# EasyEDA Pro project ProProject_Avaota Pi A_2024-03-25.epro, schematic Avaota Pi A, sheets 1 to 5 of 13

## Sheets
1 POWER
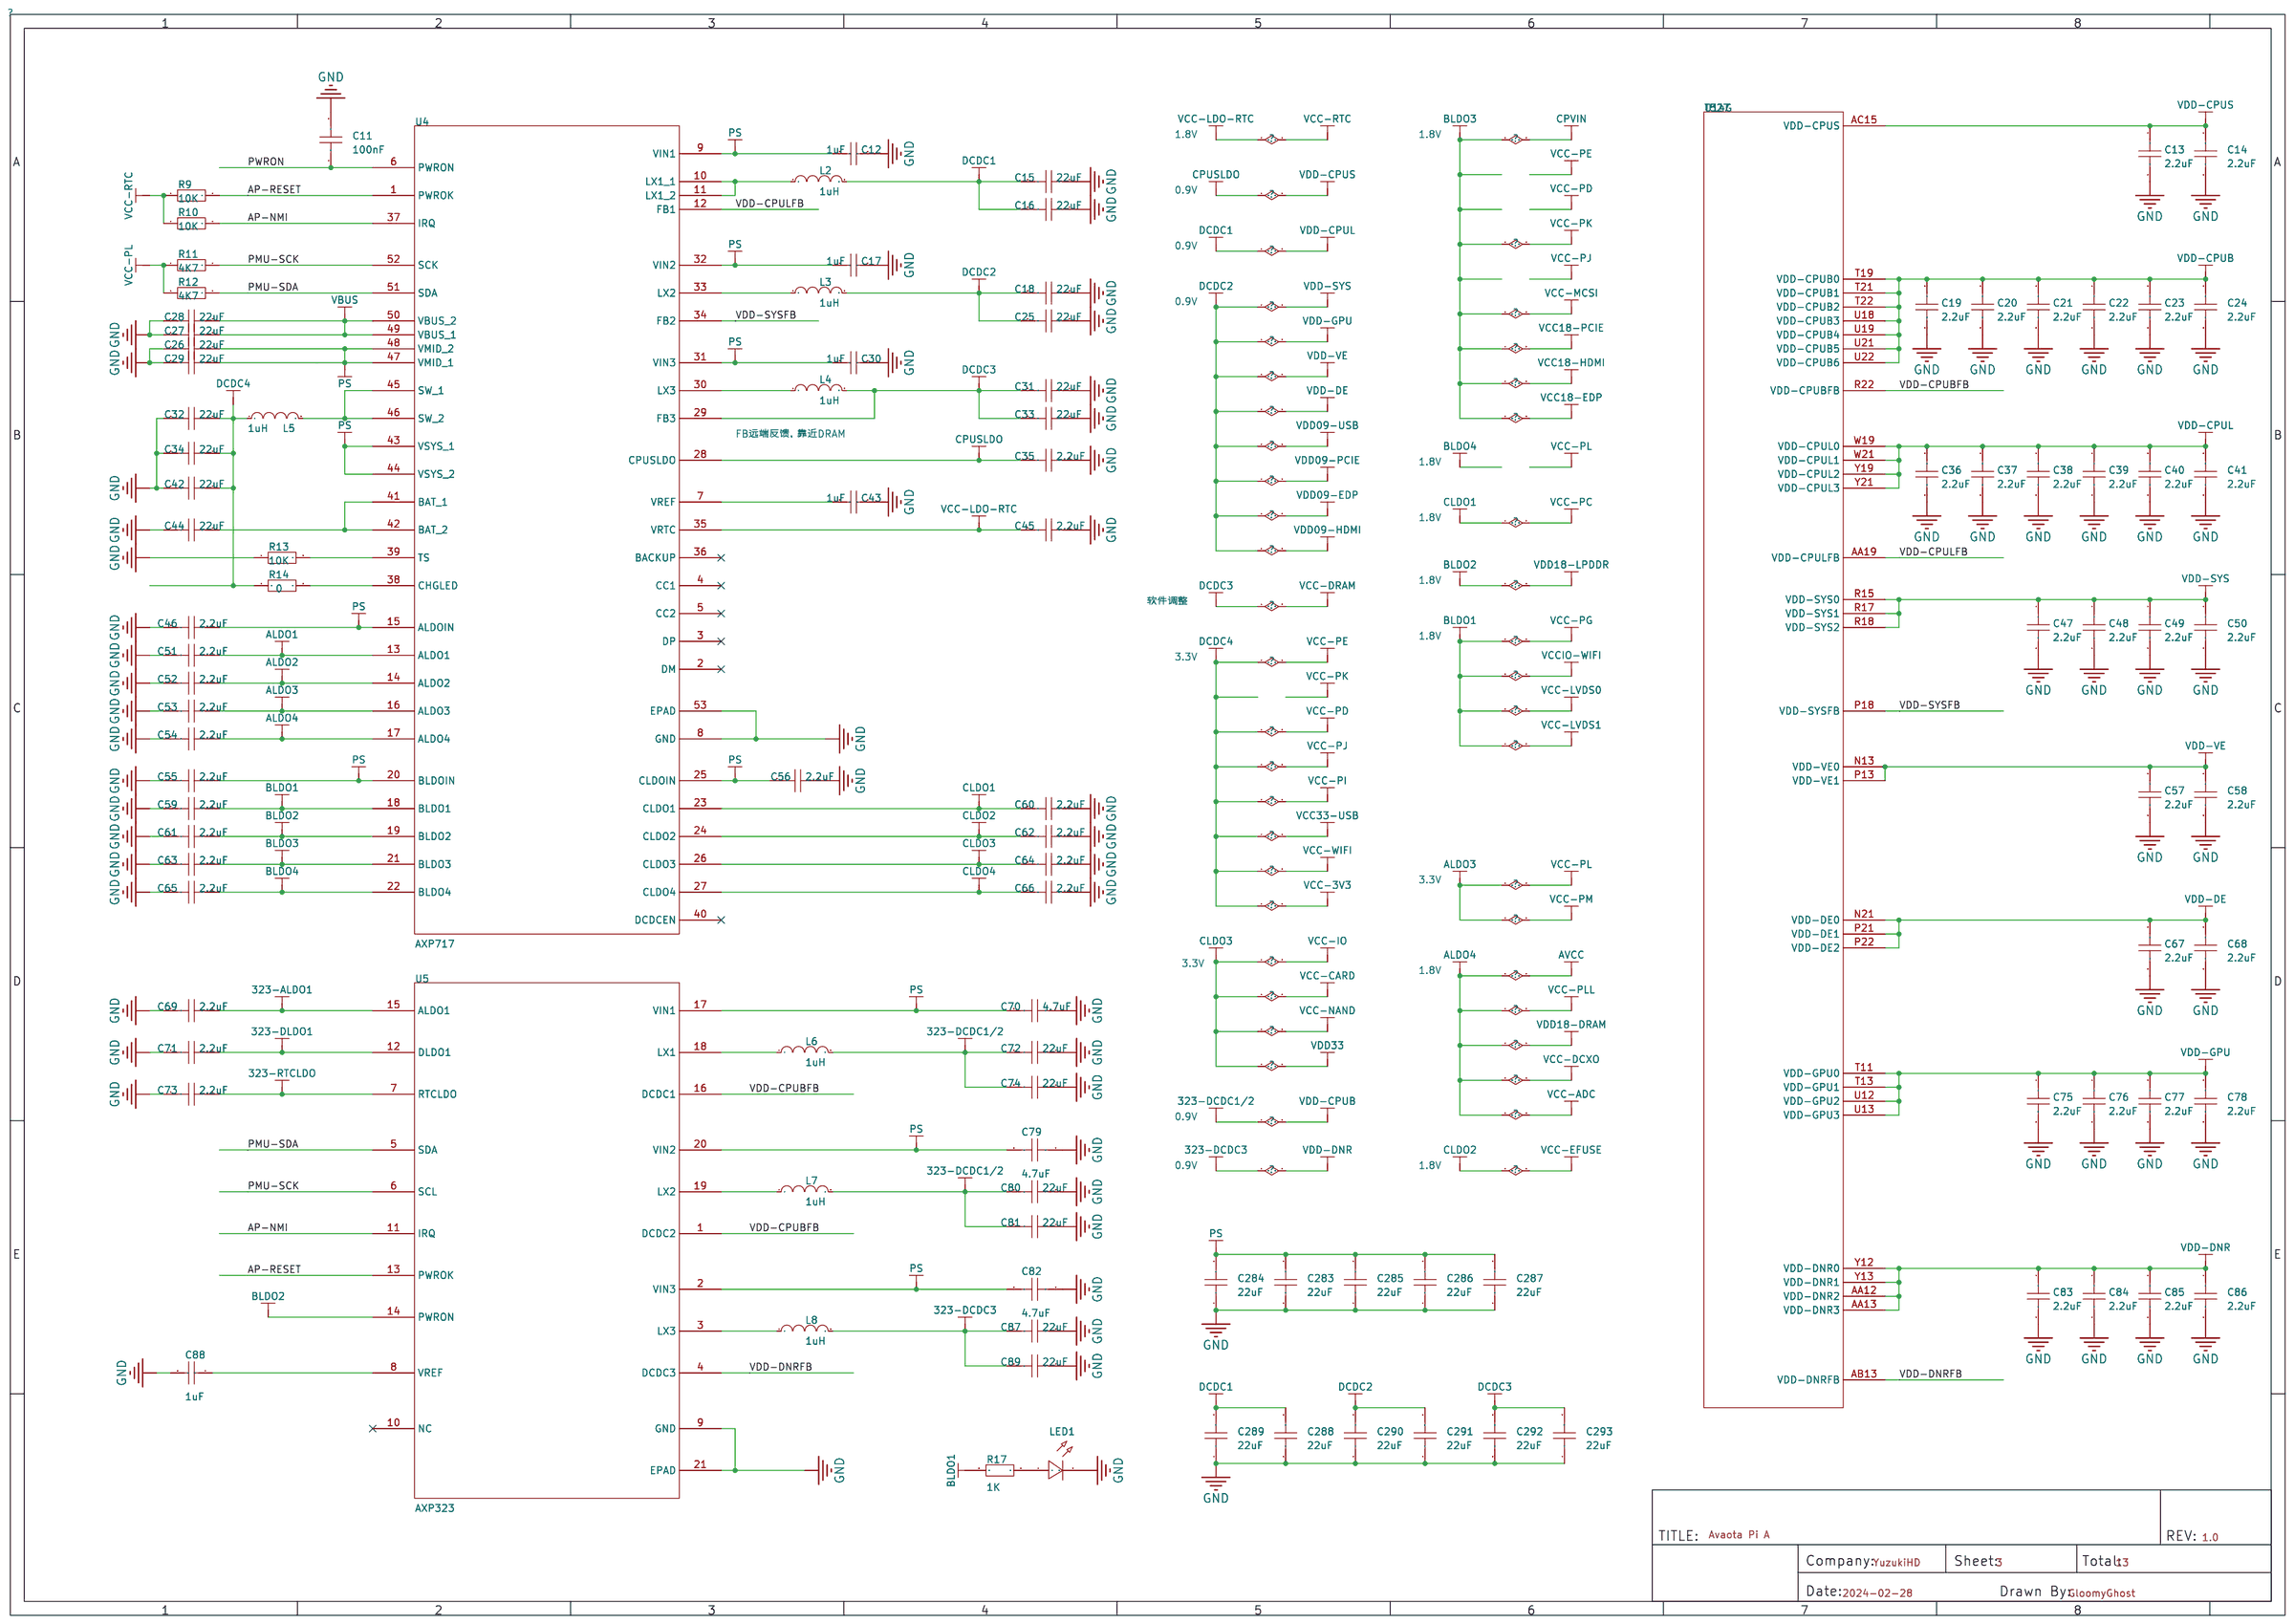
[diagram p2: POWER]
2 SYSTEM
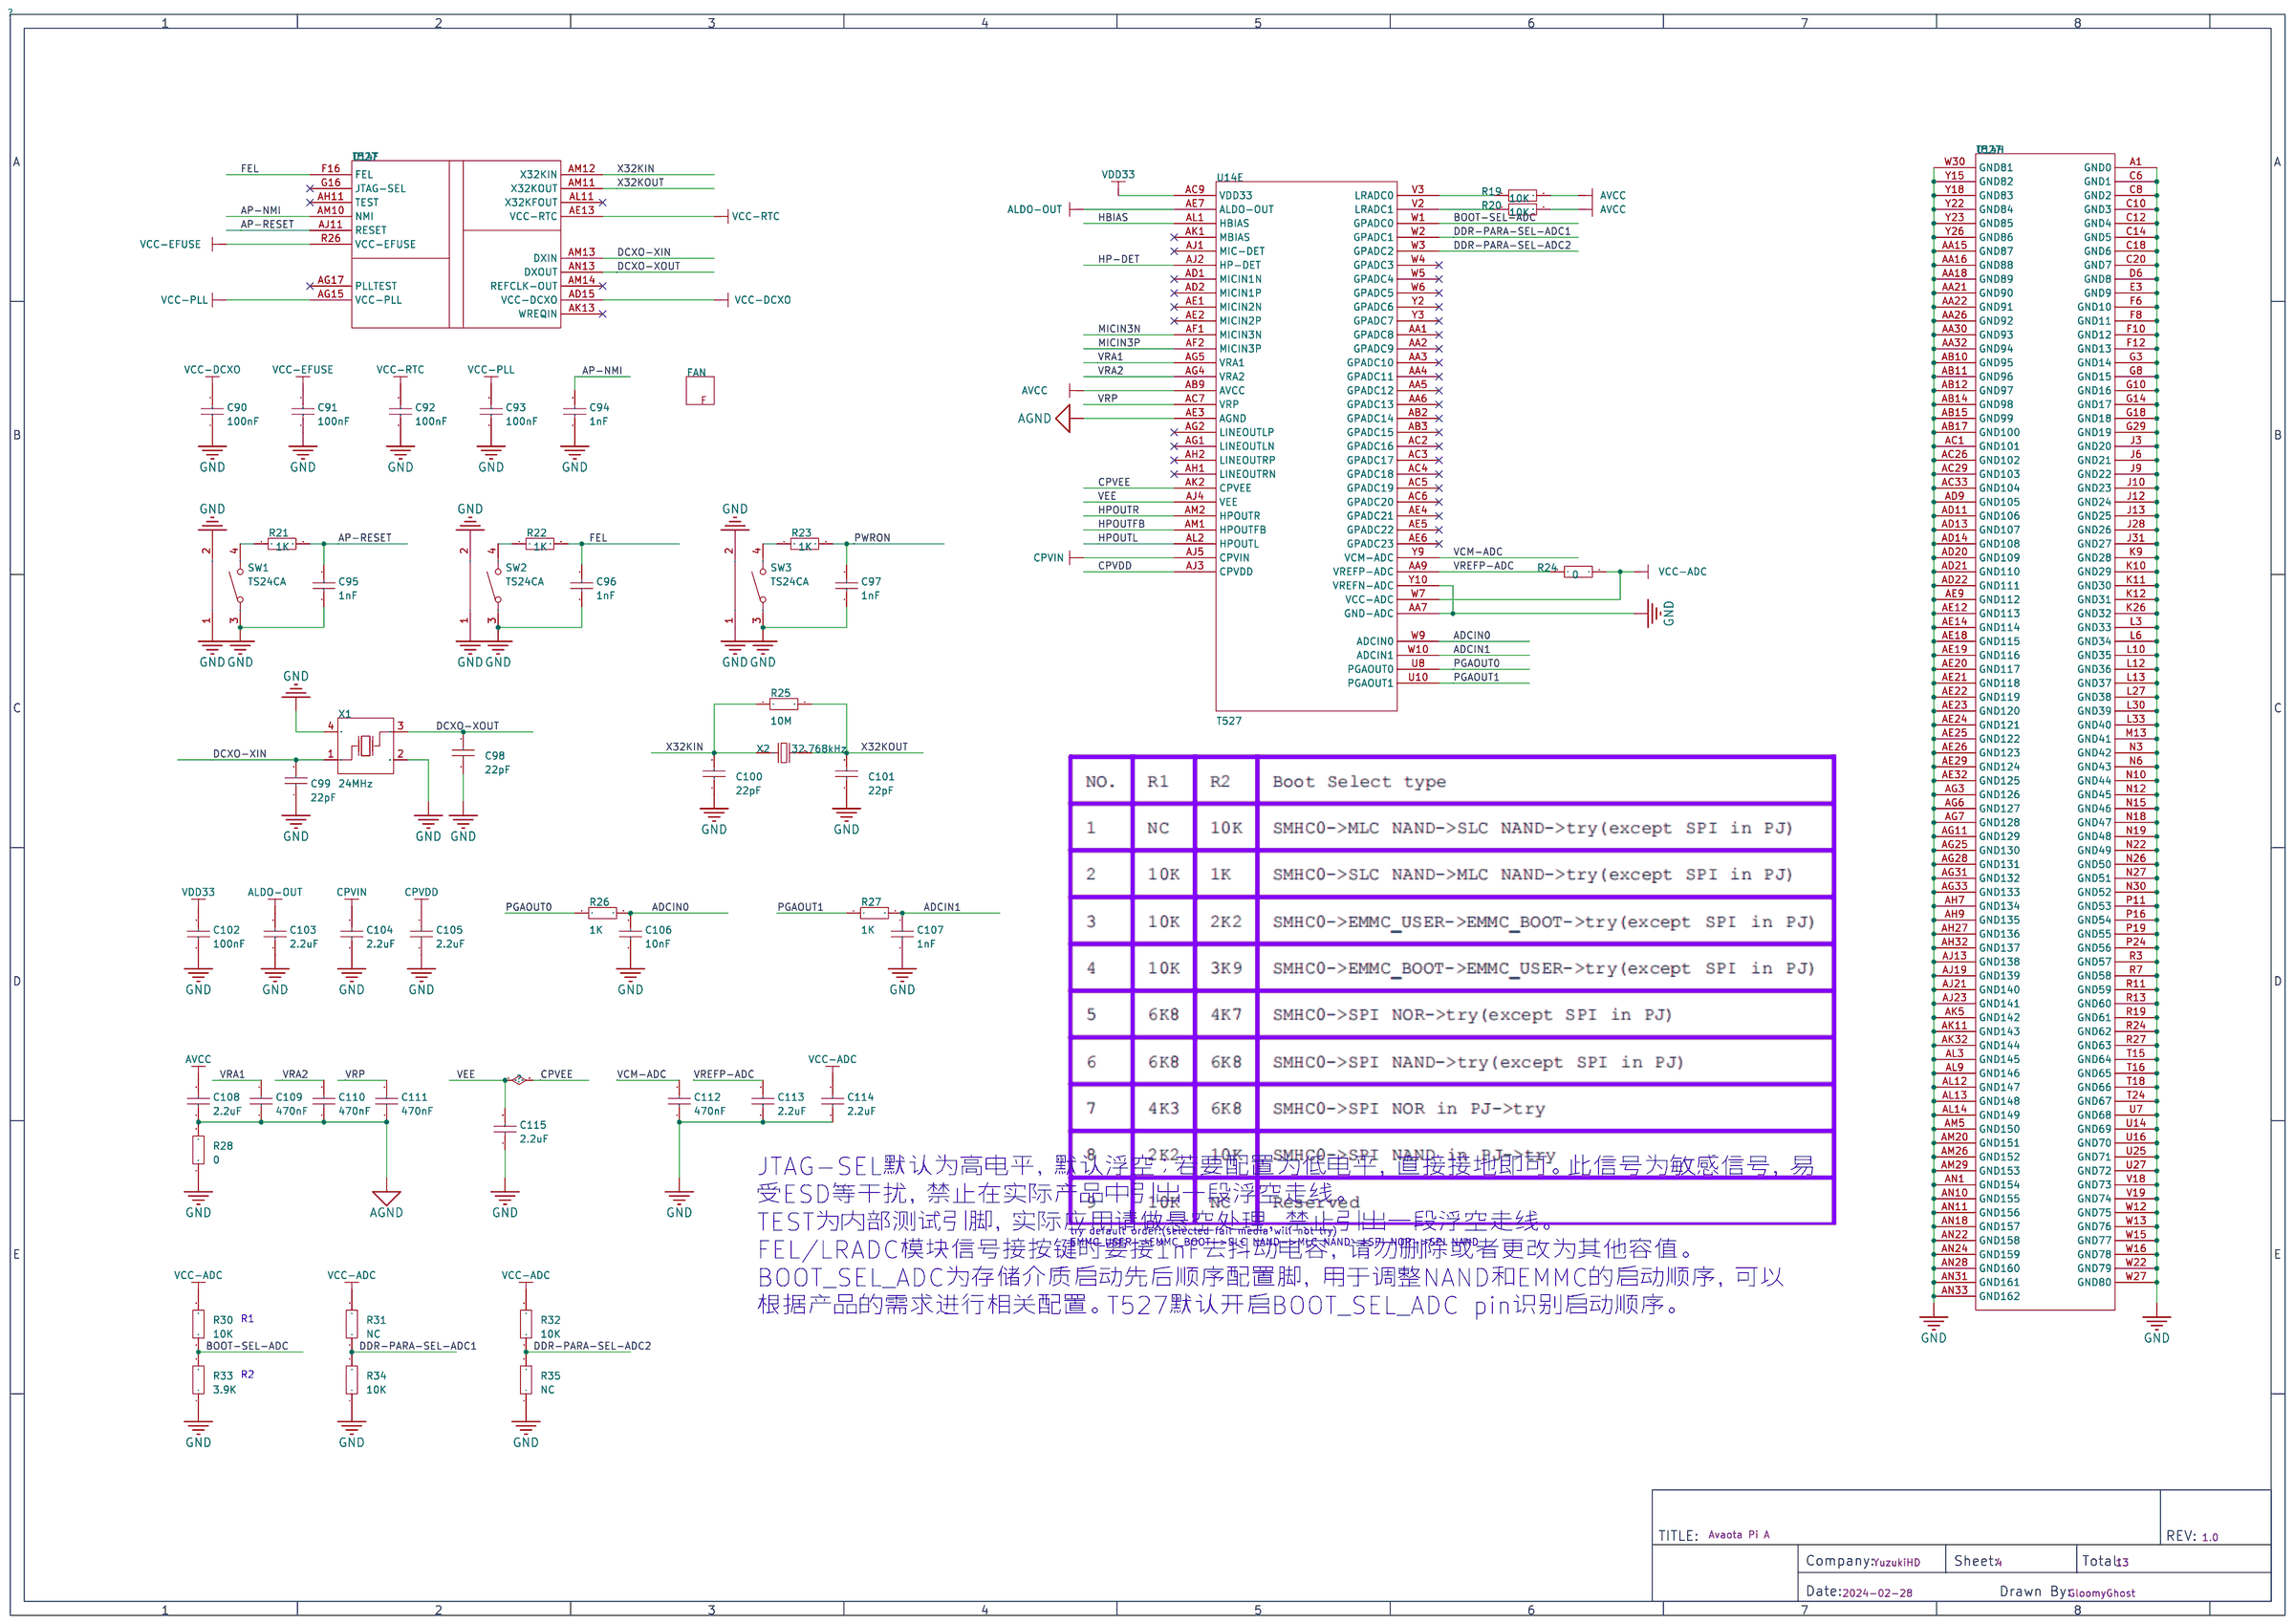
[diagram p3: SYSTEM]
3 DRAM
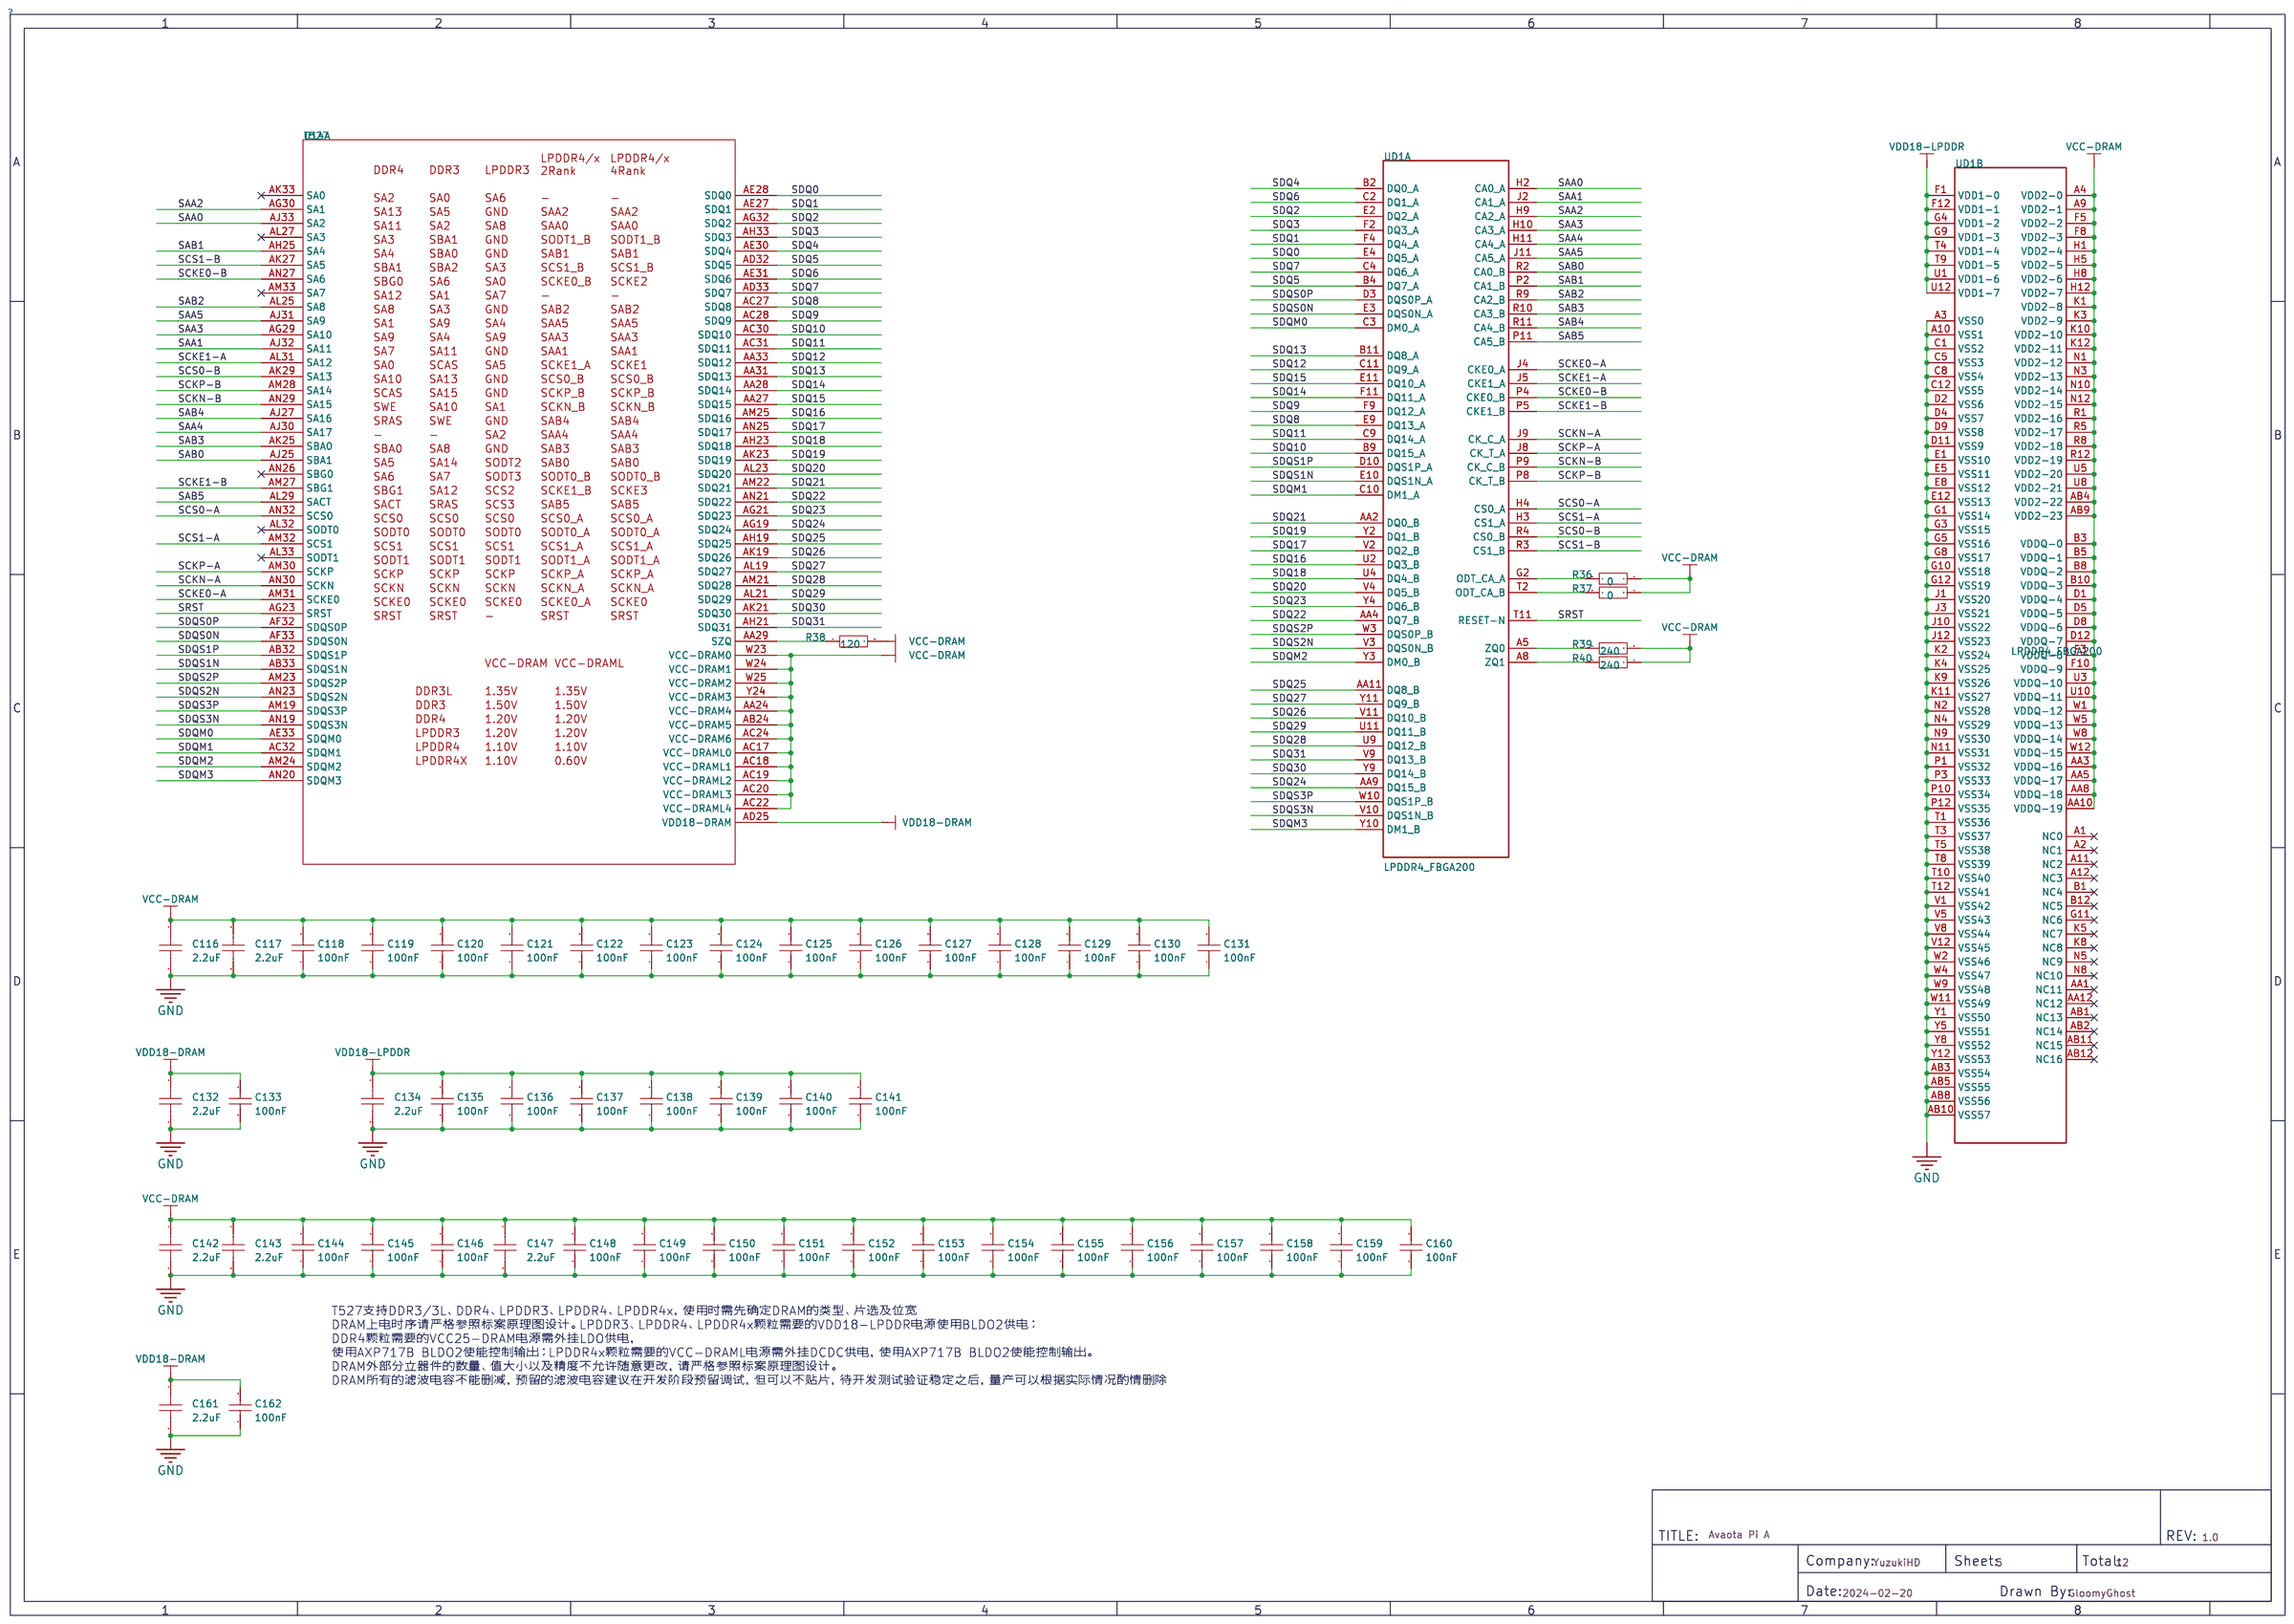
[diagram p4: DRAM]
4 GPIO1
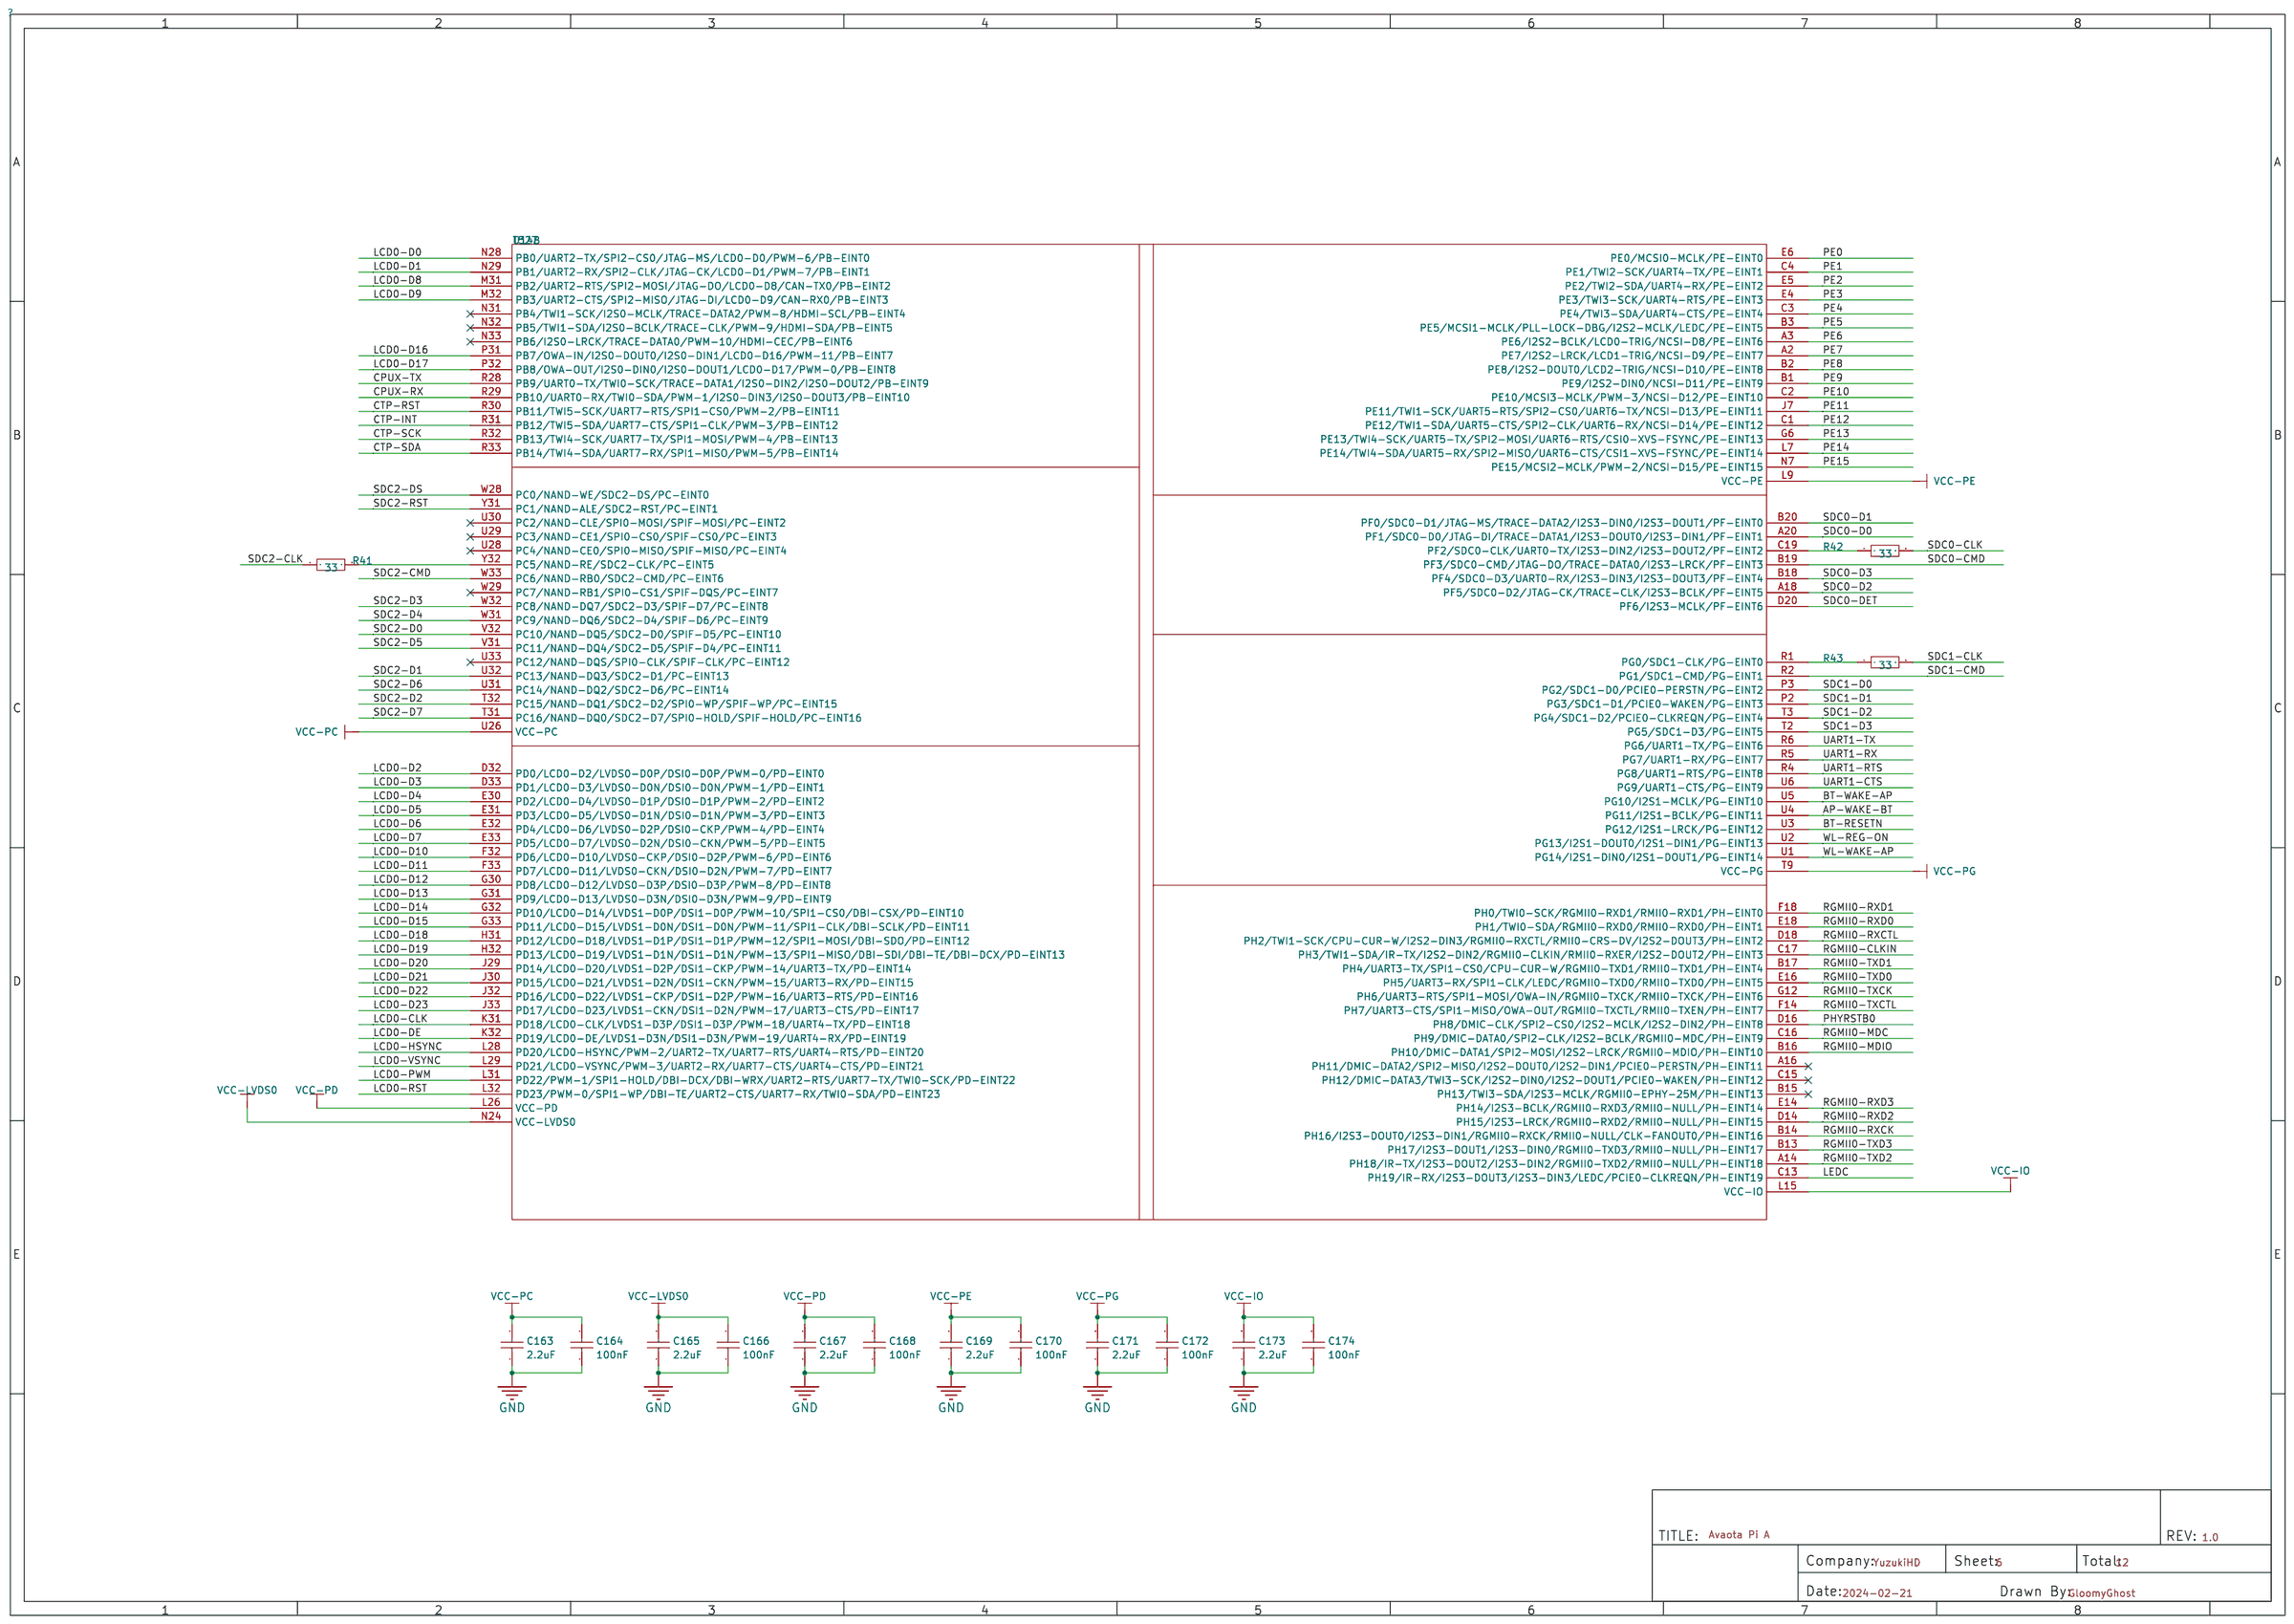
[diagram p5: GPIO1]
5 GPIO2